# EasyEDA Pro project Project_first.eprj, schematic Schematic9 (continued)
## Sheets (continued)
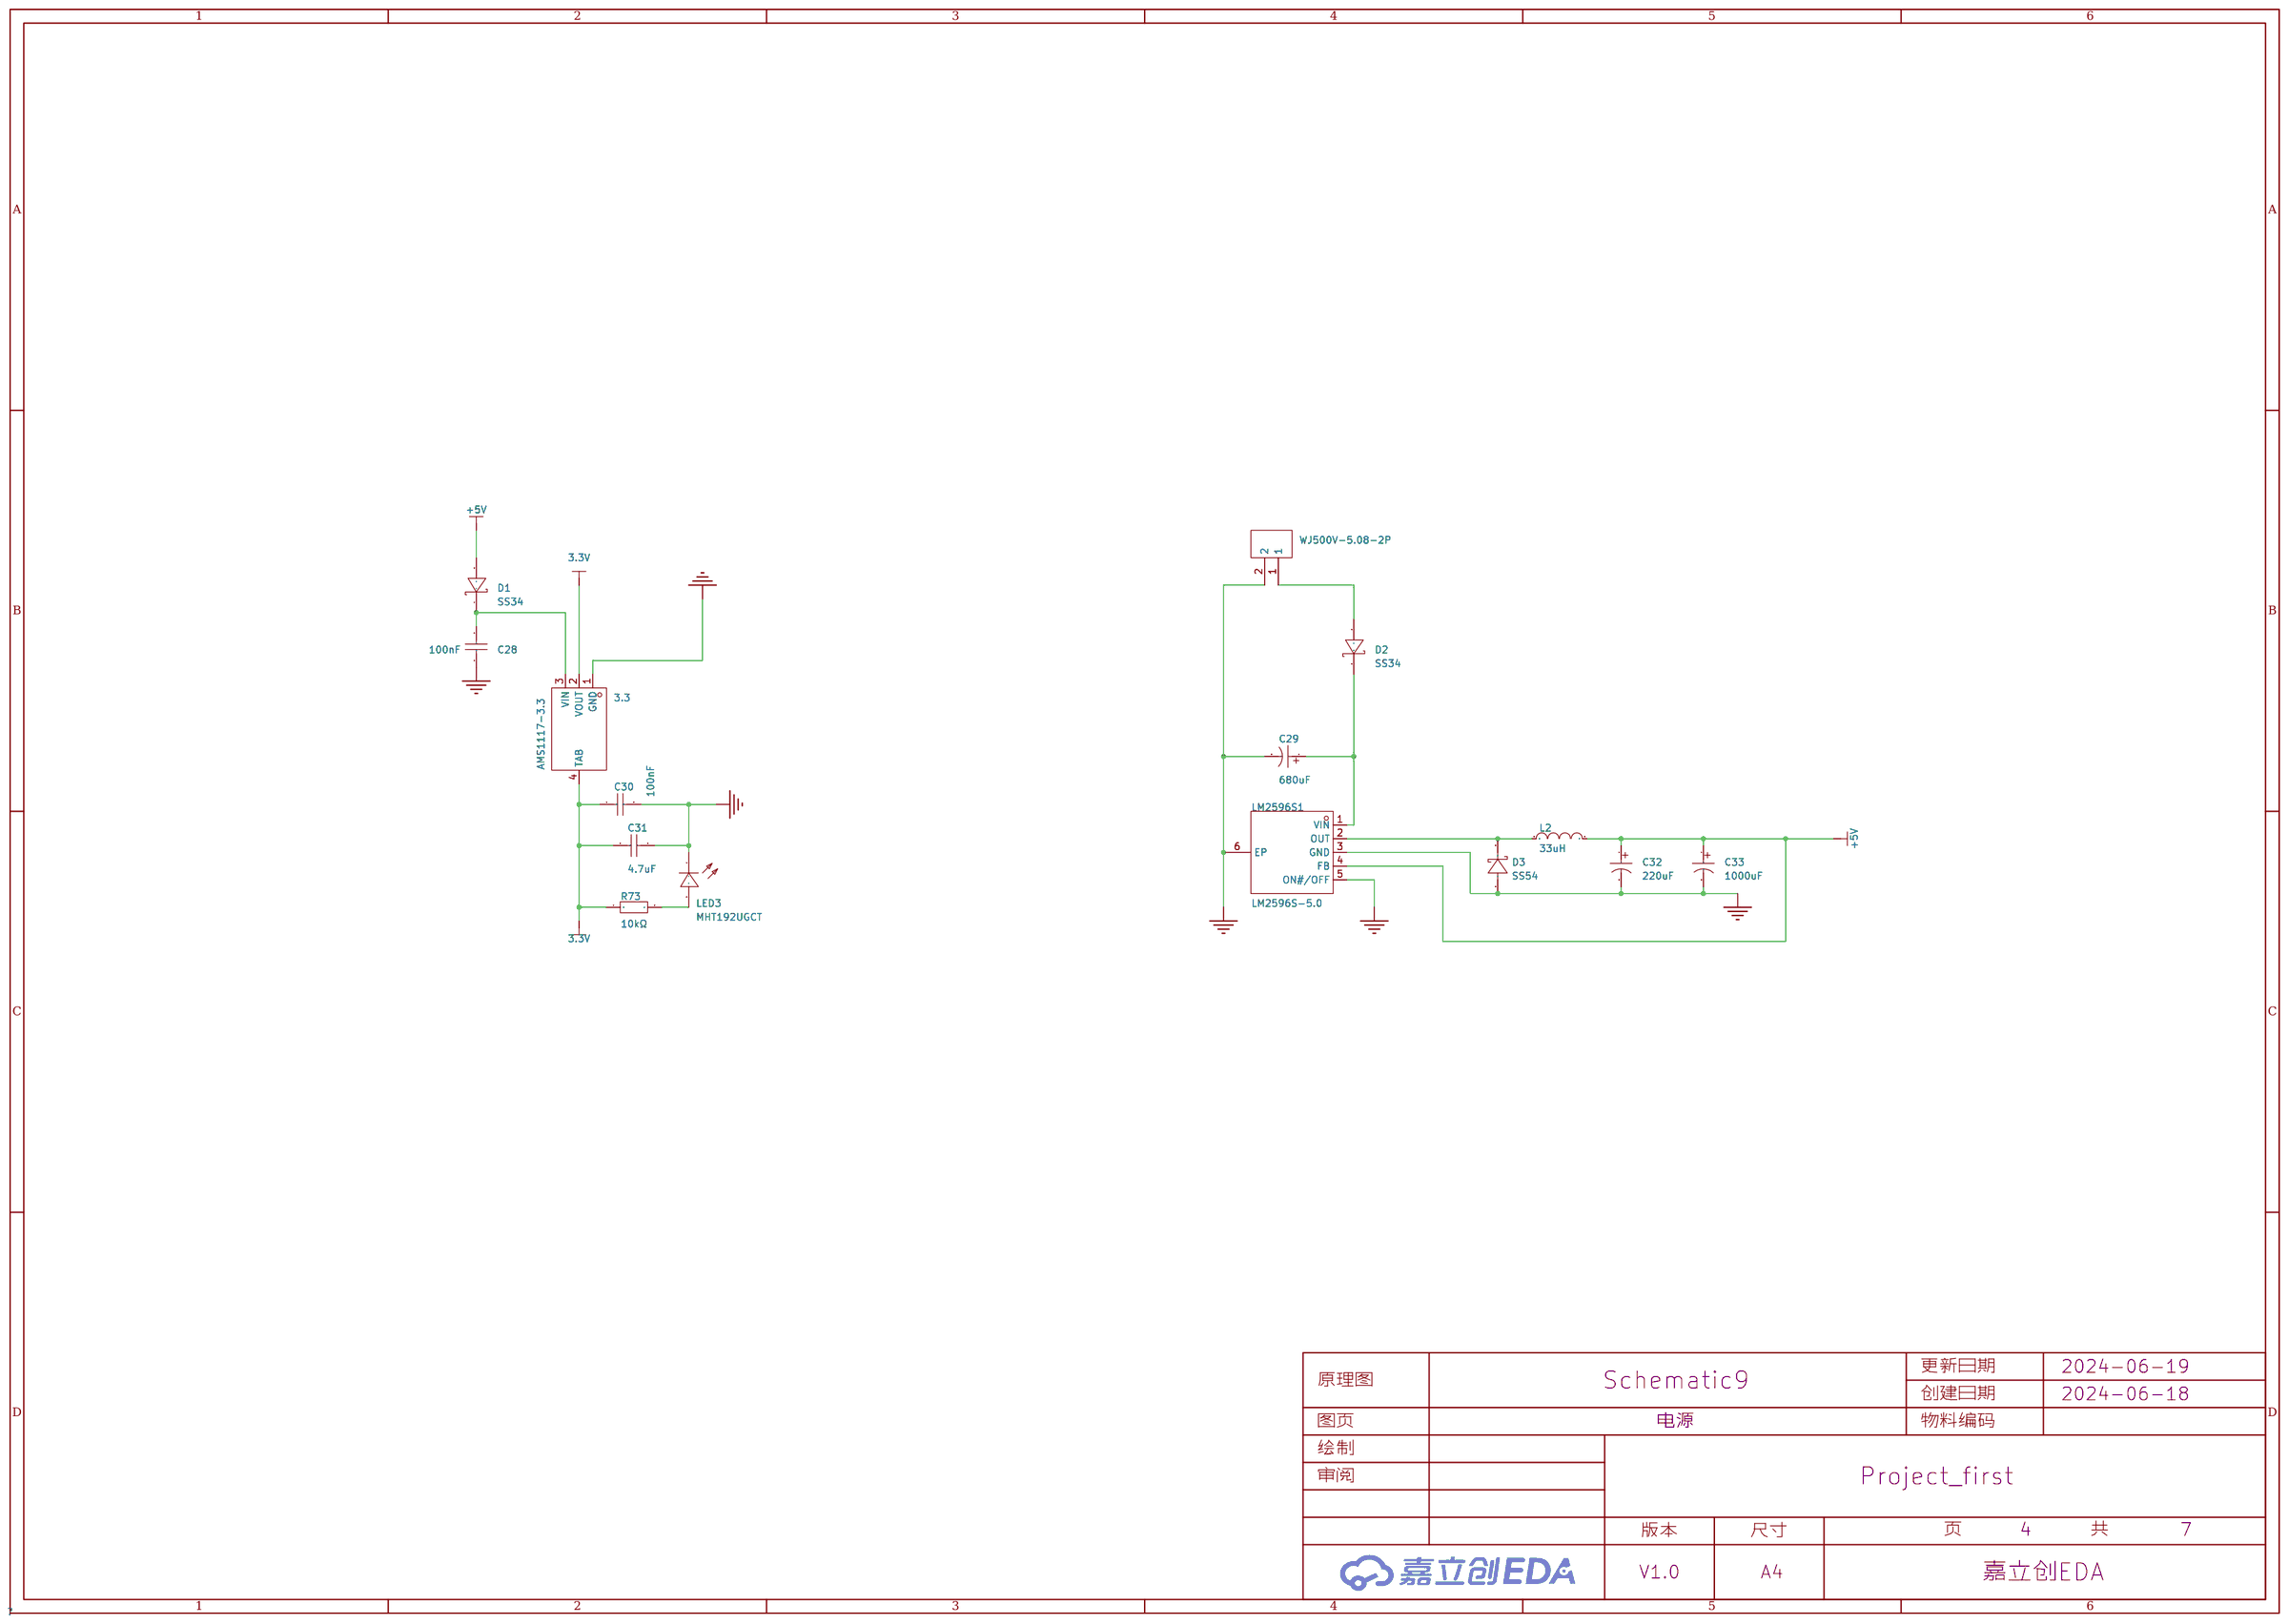
[diagram p13: 电源]
5 485: Create Date: 2024-06-18; Page Name: 485
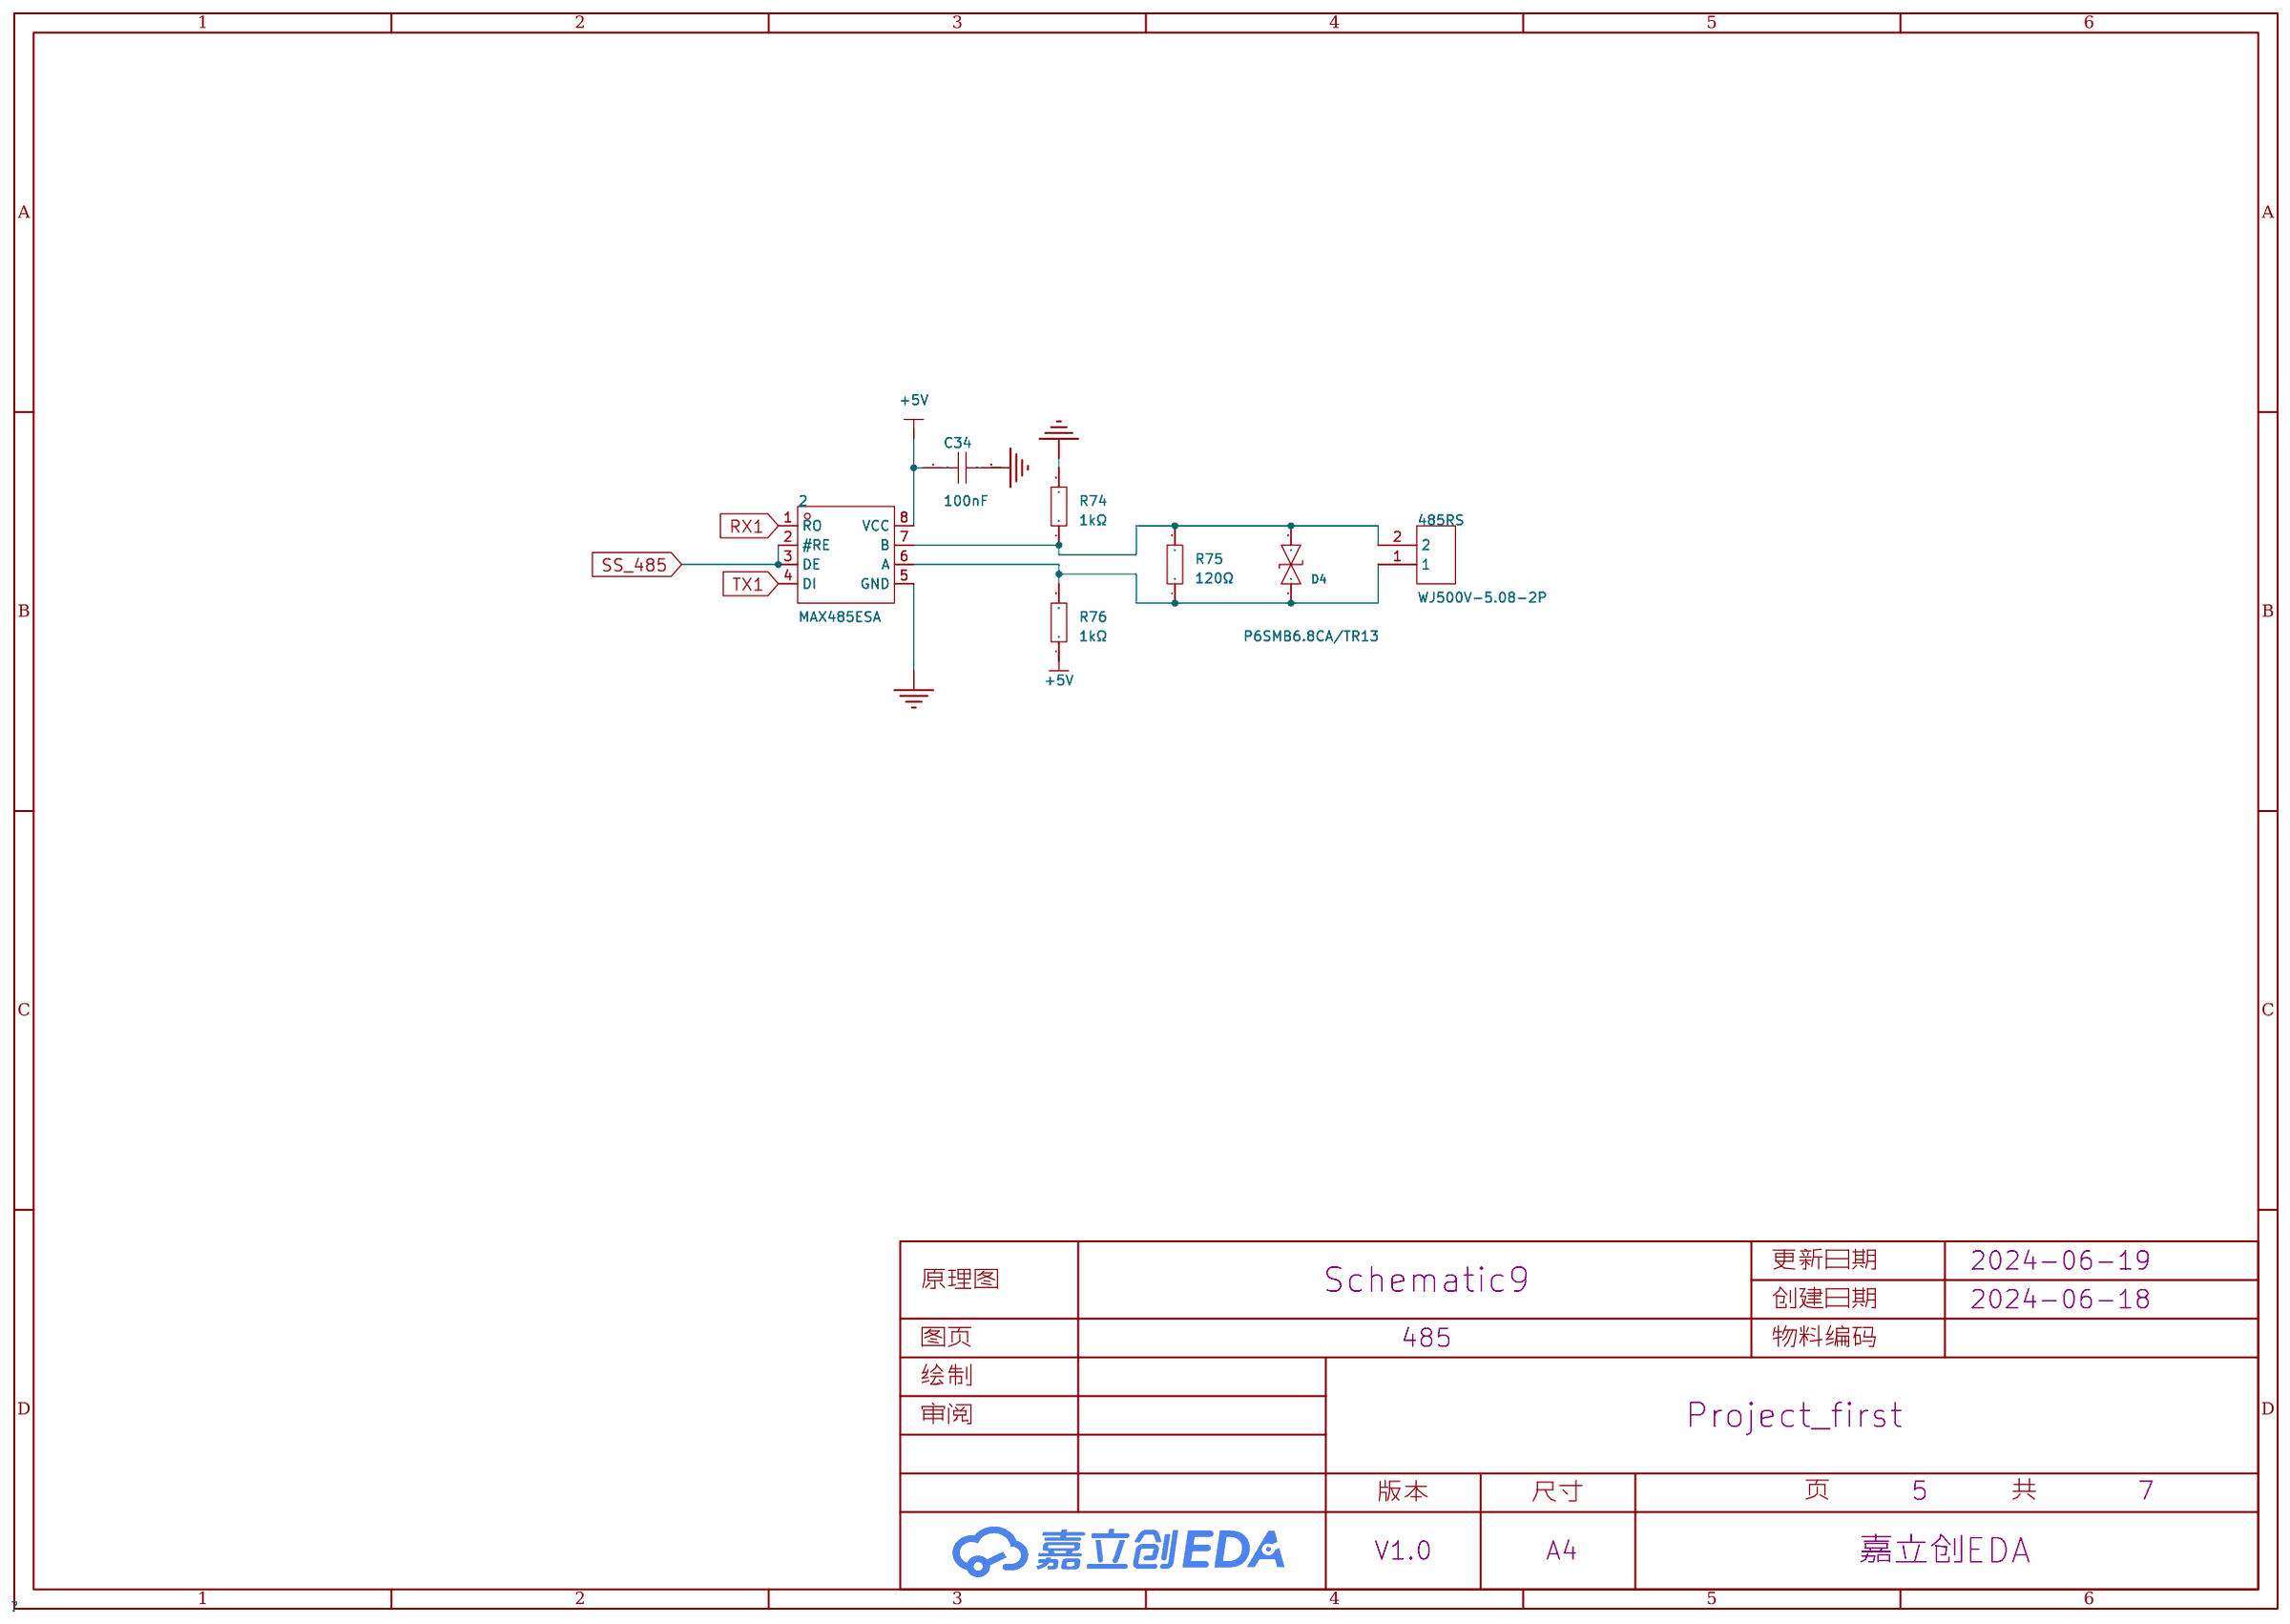
[diagram p14: 485]
6 sp232: Create Date: 2024-06-18; Page Name: sp232
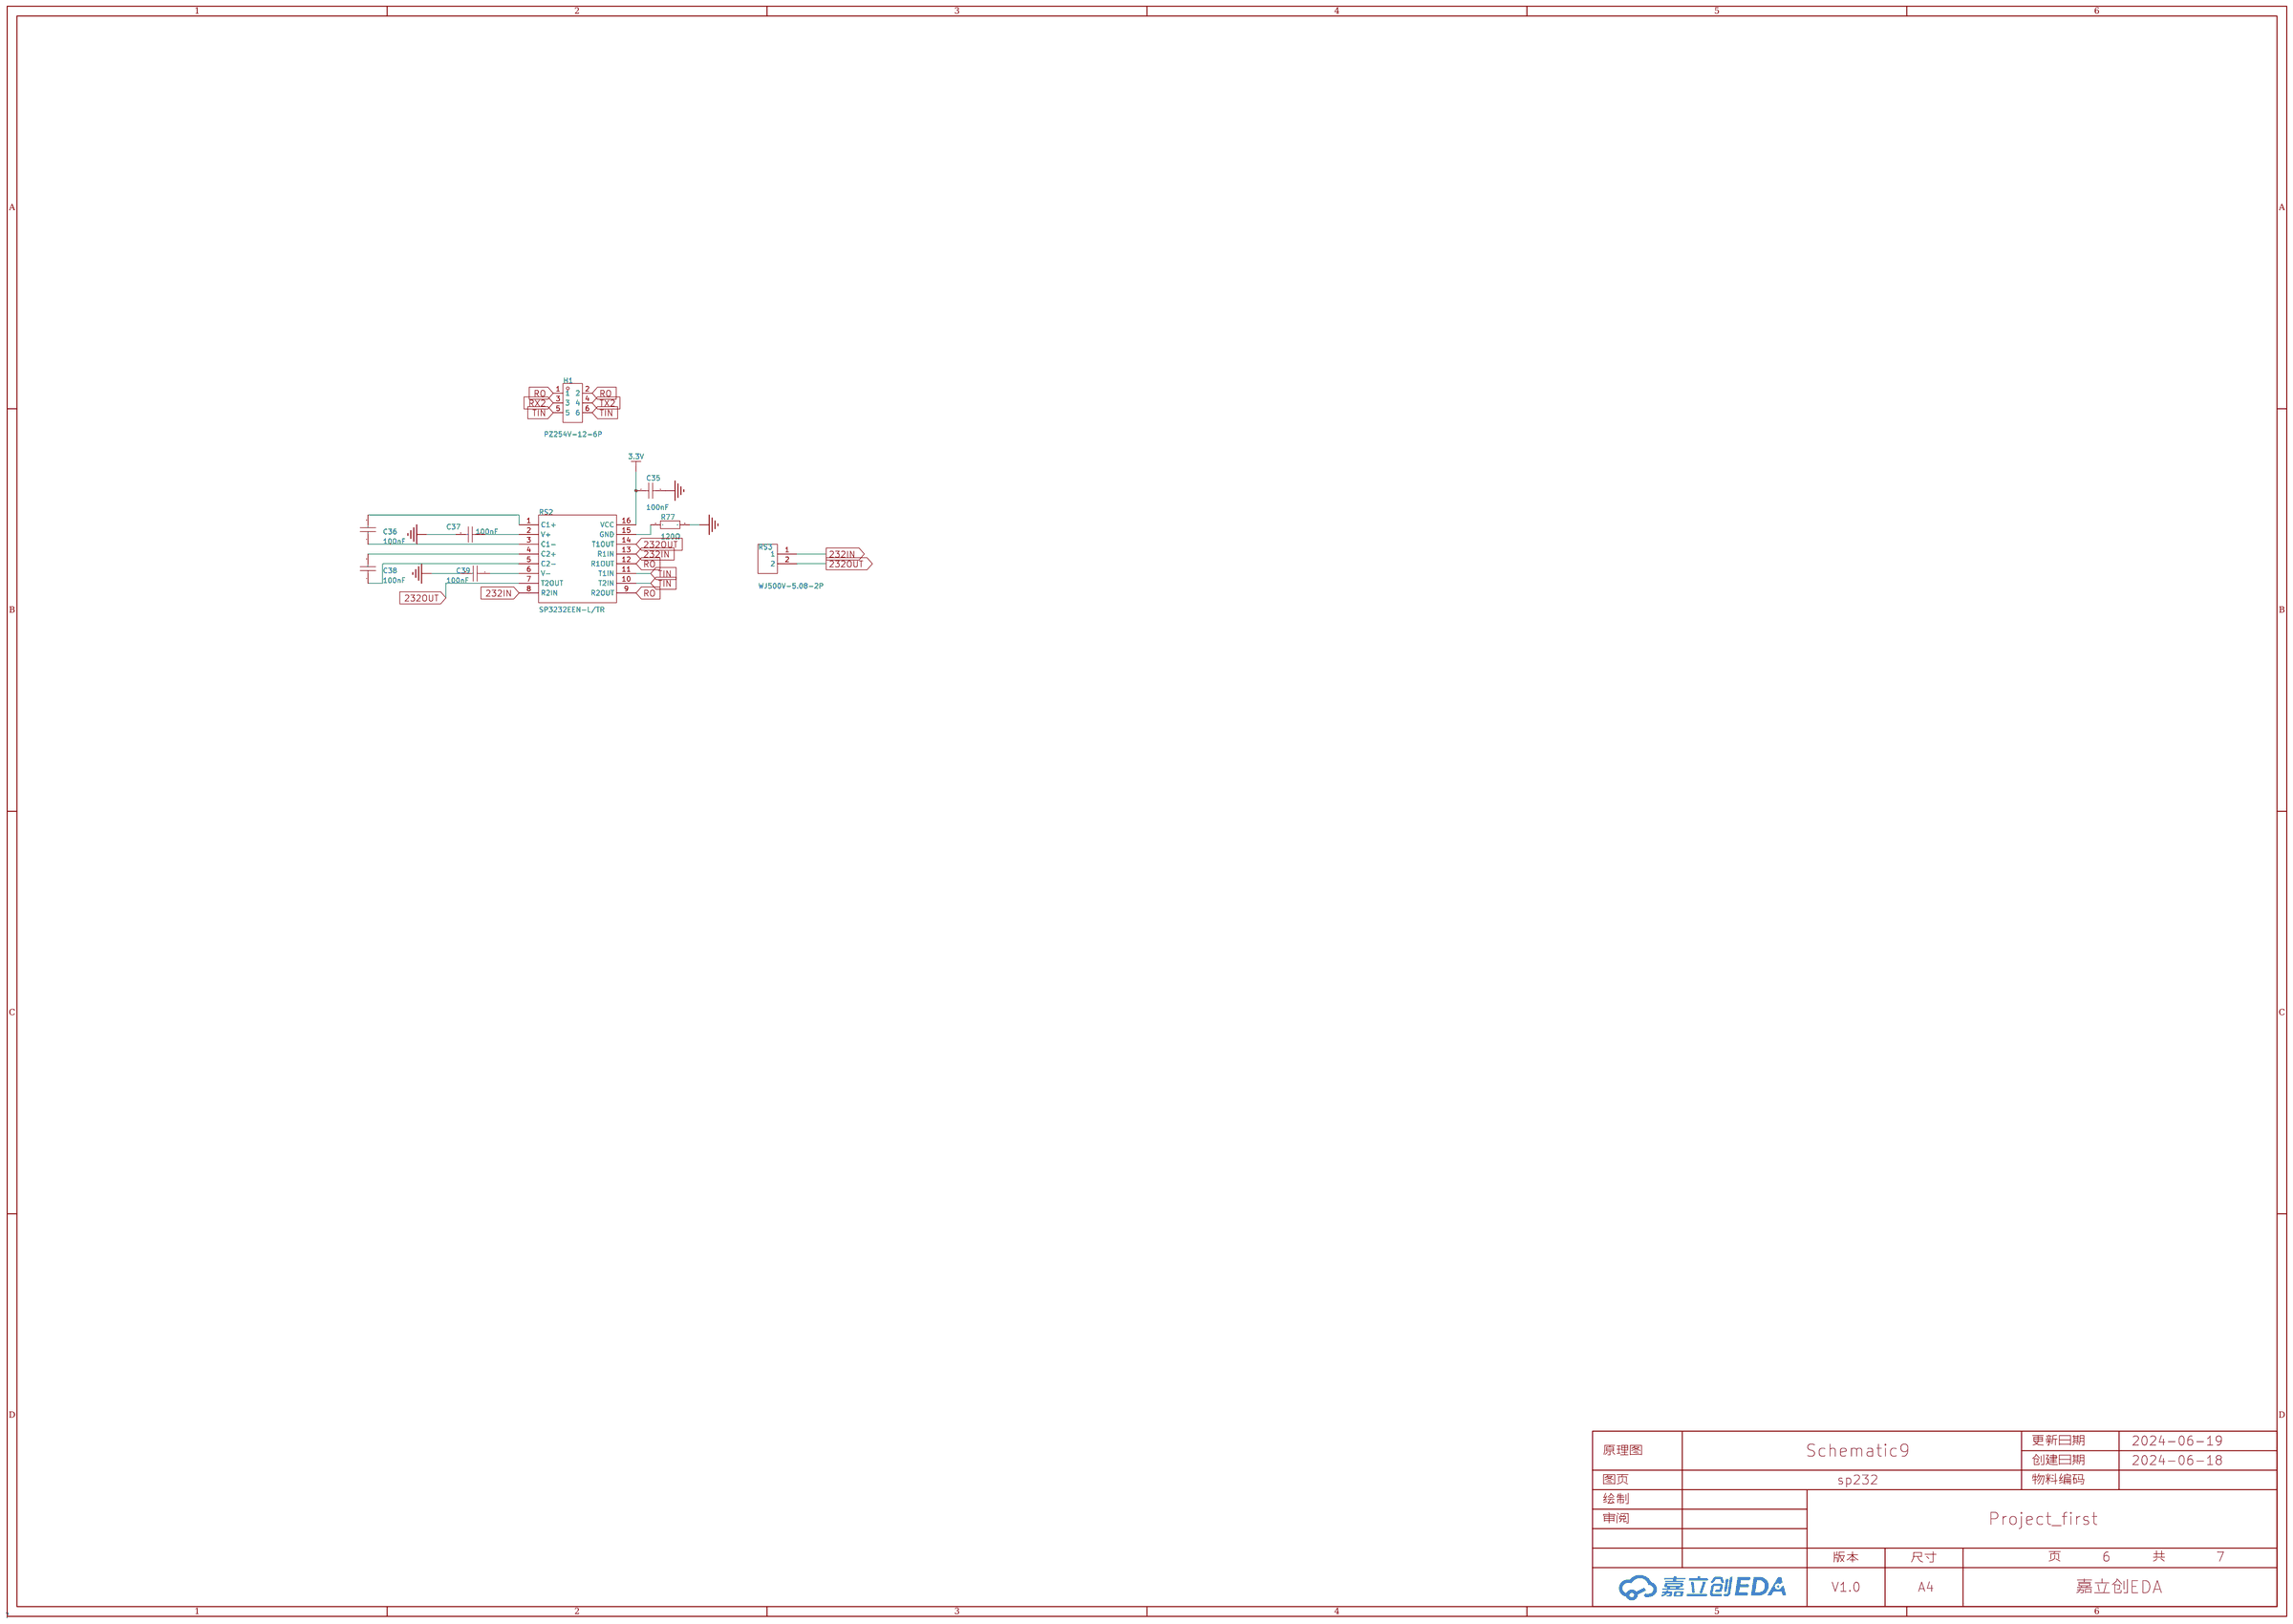
[diagram p15: sp232]
7 can: Create Date: 2024-06-18; Page Name: can
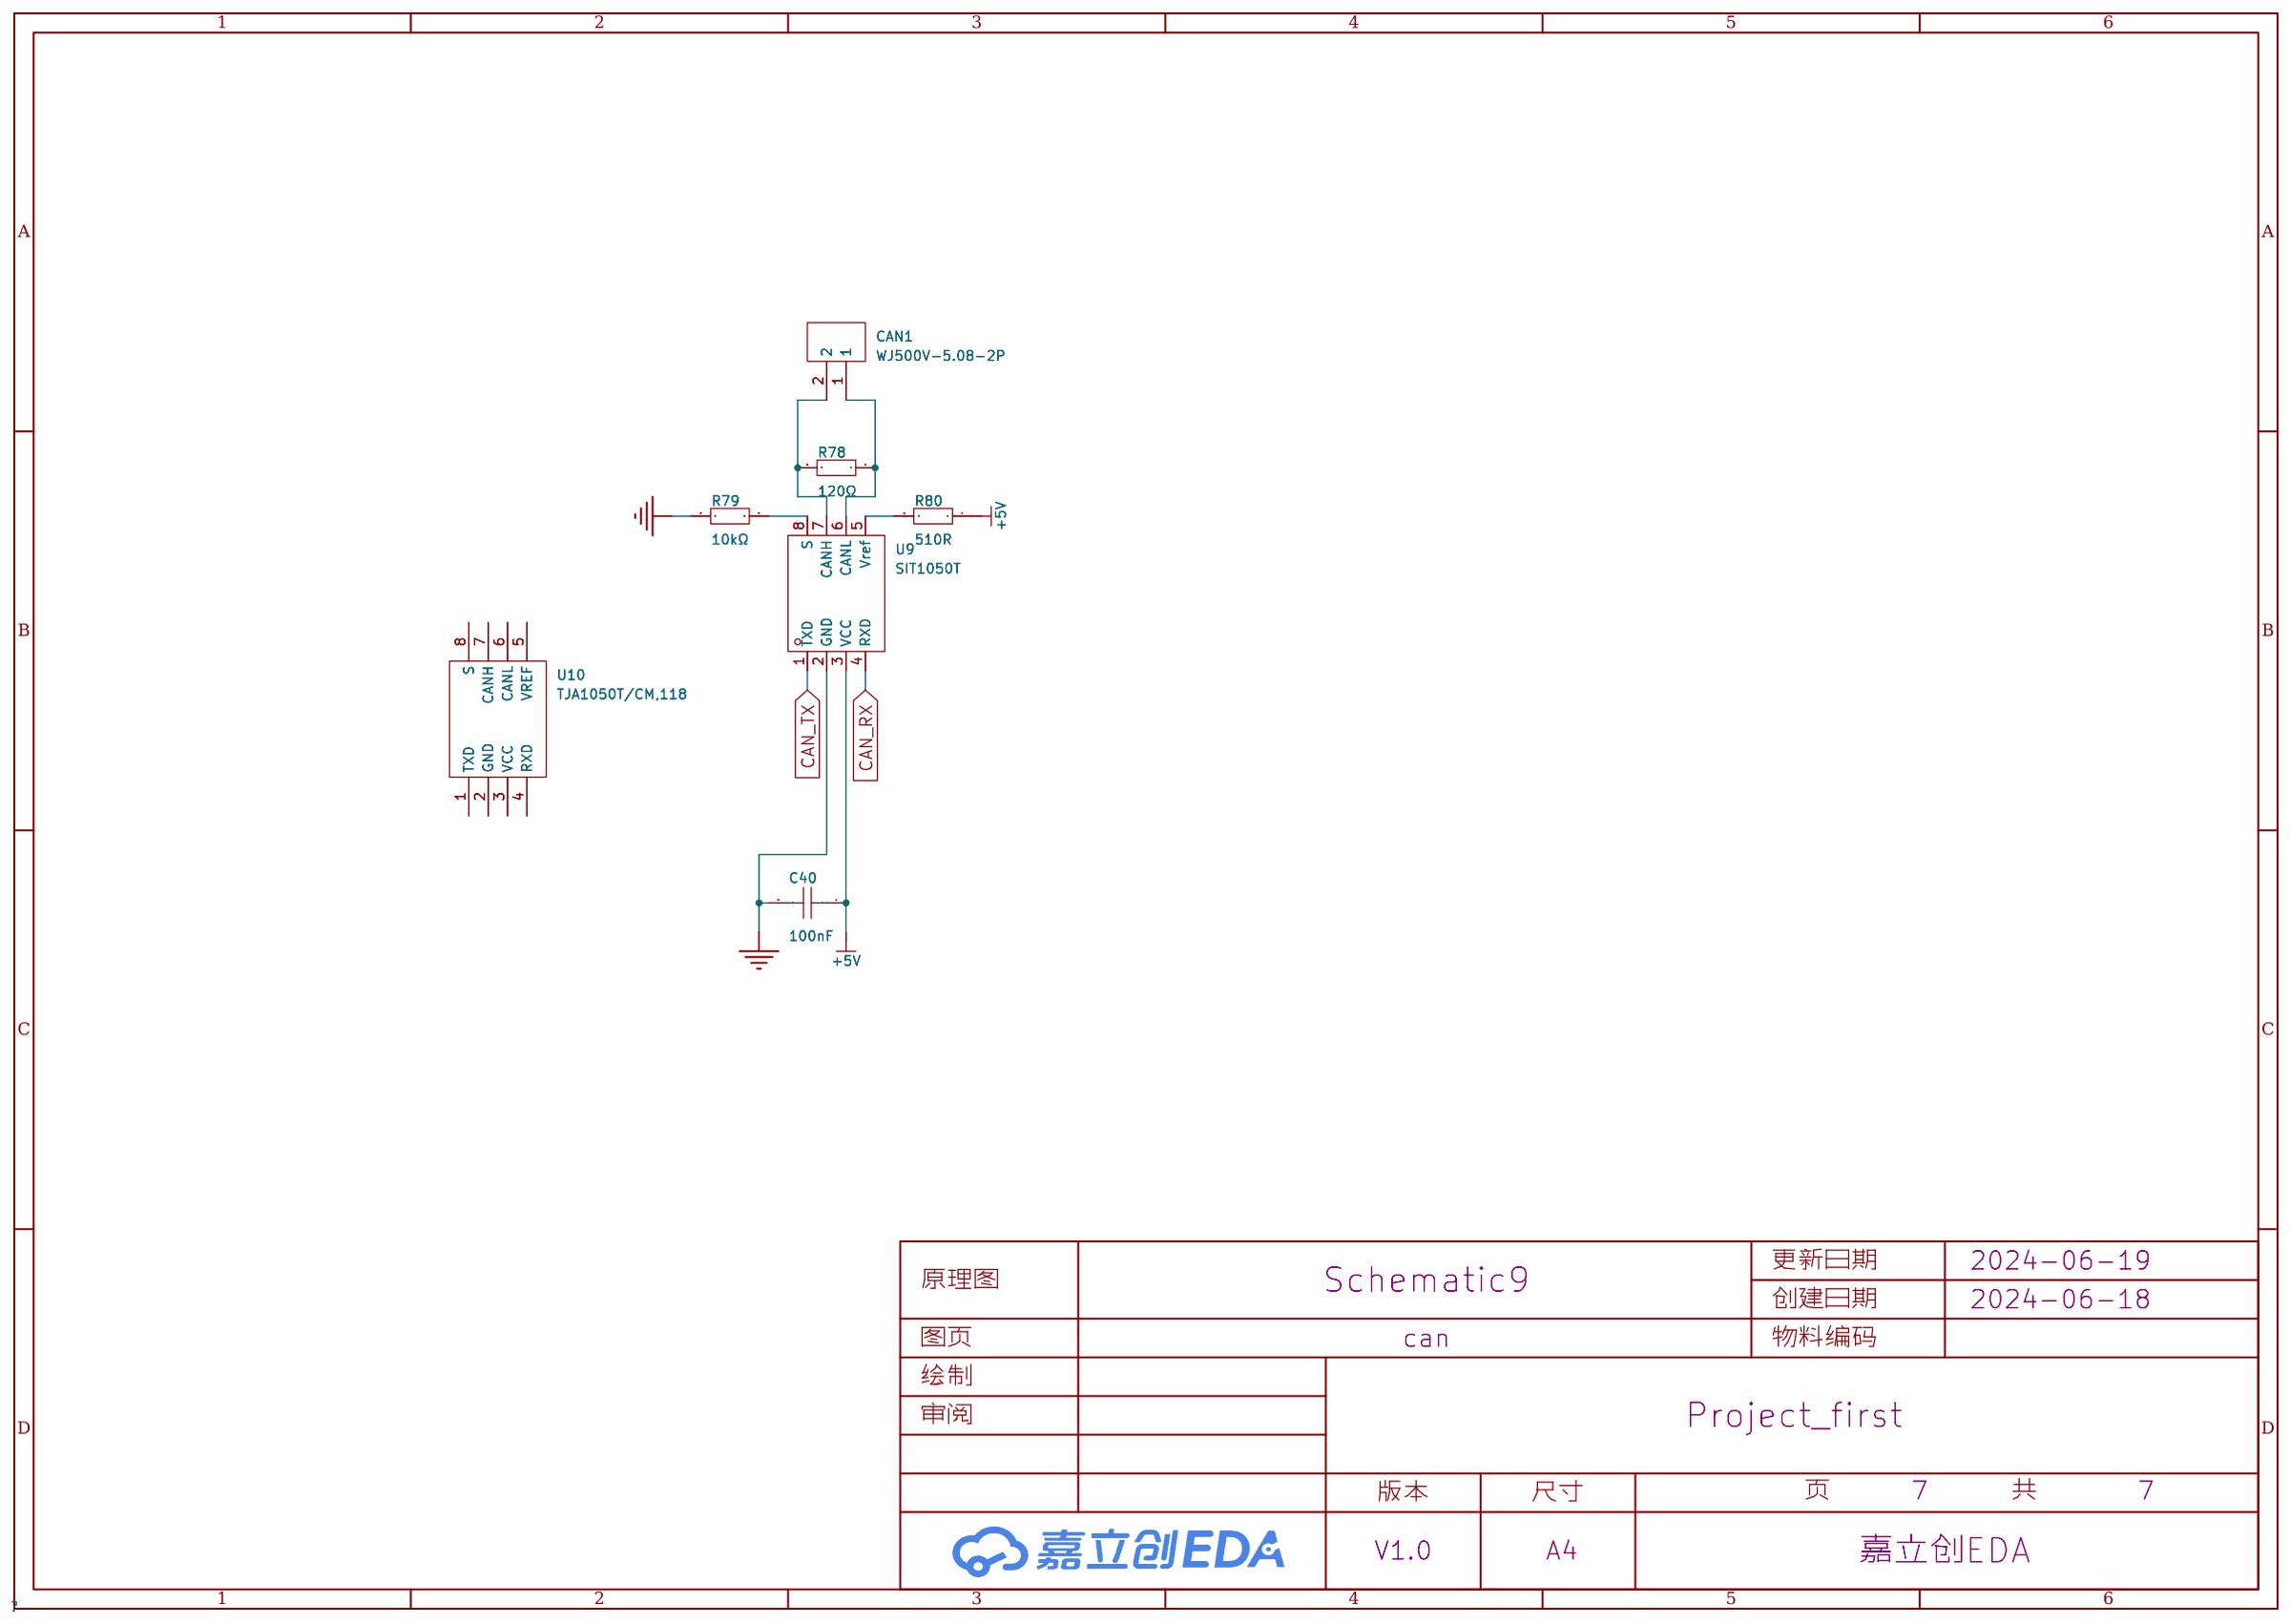
[diagram p16: can]

## Parts
sheet 485
2  MAX485ESA  [SOP-8_L5.0-W4.0-P1.27-LS6.0-BL]
485RS  WJ500V-5.08-2P  [CONN-TH_2P-P5.00_WJ500V-5.08-2P]
C34  100nF  [C0603]
D4  P6SMB6.8CA/TR13  [SMB_L4.6-W3.6-LS5.3-BI]
R74  1kΩ  [R0805]
R75  120Ω  [R0603]
R76  1kΩ  [R0805]
sheet can
C40  100nF  [C0603]
CAN1  WJ500V-5.08-2P  [CONN-TH_2P-P5.00_WJ500V-5.08-2P]
R78  120Ω  [R0603]
R79  10kΩ  [R0603]
R80  510R  [R0805]
U9  SIT1050T  [SO-8_L4.9-W3.9-P1.27-LS5.9-BL]
U10  TJA1050T/CM,118  [SOIC-8_L5.0-W4.0-P1.27-LS6.0-BL]
sheet mcu_复位电路错误
8M1  8MHz  [HC-49US_L11.5-W4.5-P4.88]
32.768k1  32.768kHz  [FC-135R_L3.2-W1.5]
74HSS  PZ254V-11-02P  [HDR-TH_2P-P2.54-V-M]
C1  20pF  [C0805]
C2  9pF  [C0805]
C3  20pF  [C0805]
C4  9pF  [C0805]
C5  1uF  [C0805]
C6  100nF  [C0603]
C7  100nF  [C0603]
C8  100nF  [C0603]
C9  100nF  [C0603]
C41  1uF  [C0805]
CAN  PZ254V-11-02P  [HDR-TH_2P-P2.54-V-M]
Debug1  PZ254V-11-04P  [HDR-TH_4P-P2.54-V-M]
LED1  MHT192UGCT  [LED0603-RD_GREEN]
LED2  MHT192UGCT  [LED0603-RD_GREEN]
LED4  MHT192UGCT  [LED0603-RD_GREEN]
MOD_SS  2.54-1*3P针  [HDR-TH_3P-P2.54-V-M-1]
OLED  PZ254V-11-04P  [HDR-TH_4P-P2.54-V-M]
PWM1  2.54-1*3P针  [HDR-TH_3P-P2.54-V-M-1]
PWM2  PZ254V-11-02P  [HDR-TH_2P-P2.54-V-M]
R1  10kΩ  [R0603]
R2  1kΩ  [R0805]
R3  10kΩ  [R0603]
R4  10kΩ  [R0603]
R5  10kΩ  [R0603]
R6  10kΩ  [R0603]
R81  10kΩ  [R0603]
Reset1  TS-1002S-04326C  [KEY-SMD_4P-L6.0-W6.0-P4.50-LS9.0]
Reset2  TS-1002S-04326C  [KEY-SMD_4P-L6.0-W6.0-P4.50-LS9.0]